# EasyEDA Pro project MAX2831_Standalone.eprj

# Schematic Schematic1
Create Date: 2024-09-24; Page Name: P1; Project Name: MAX2831_Standalone; Schematic Name: Schematic1; Update Date: 2024-10-01; Company: EasyEDA.com; Drawn: EasyEDA; Page Size: A4; Part Number: JLCPCB-002; Reviewed: EasyEDA; Version: V0.1
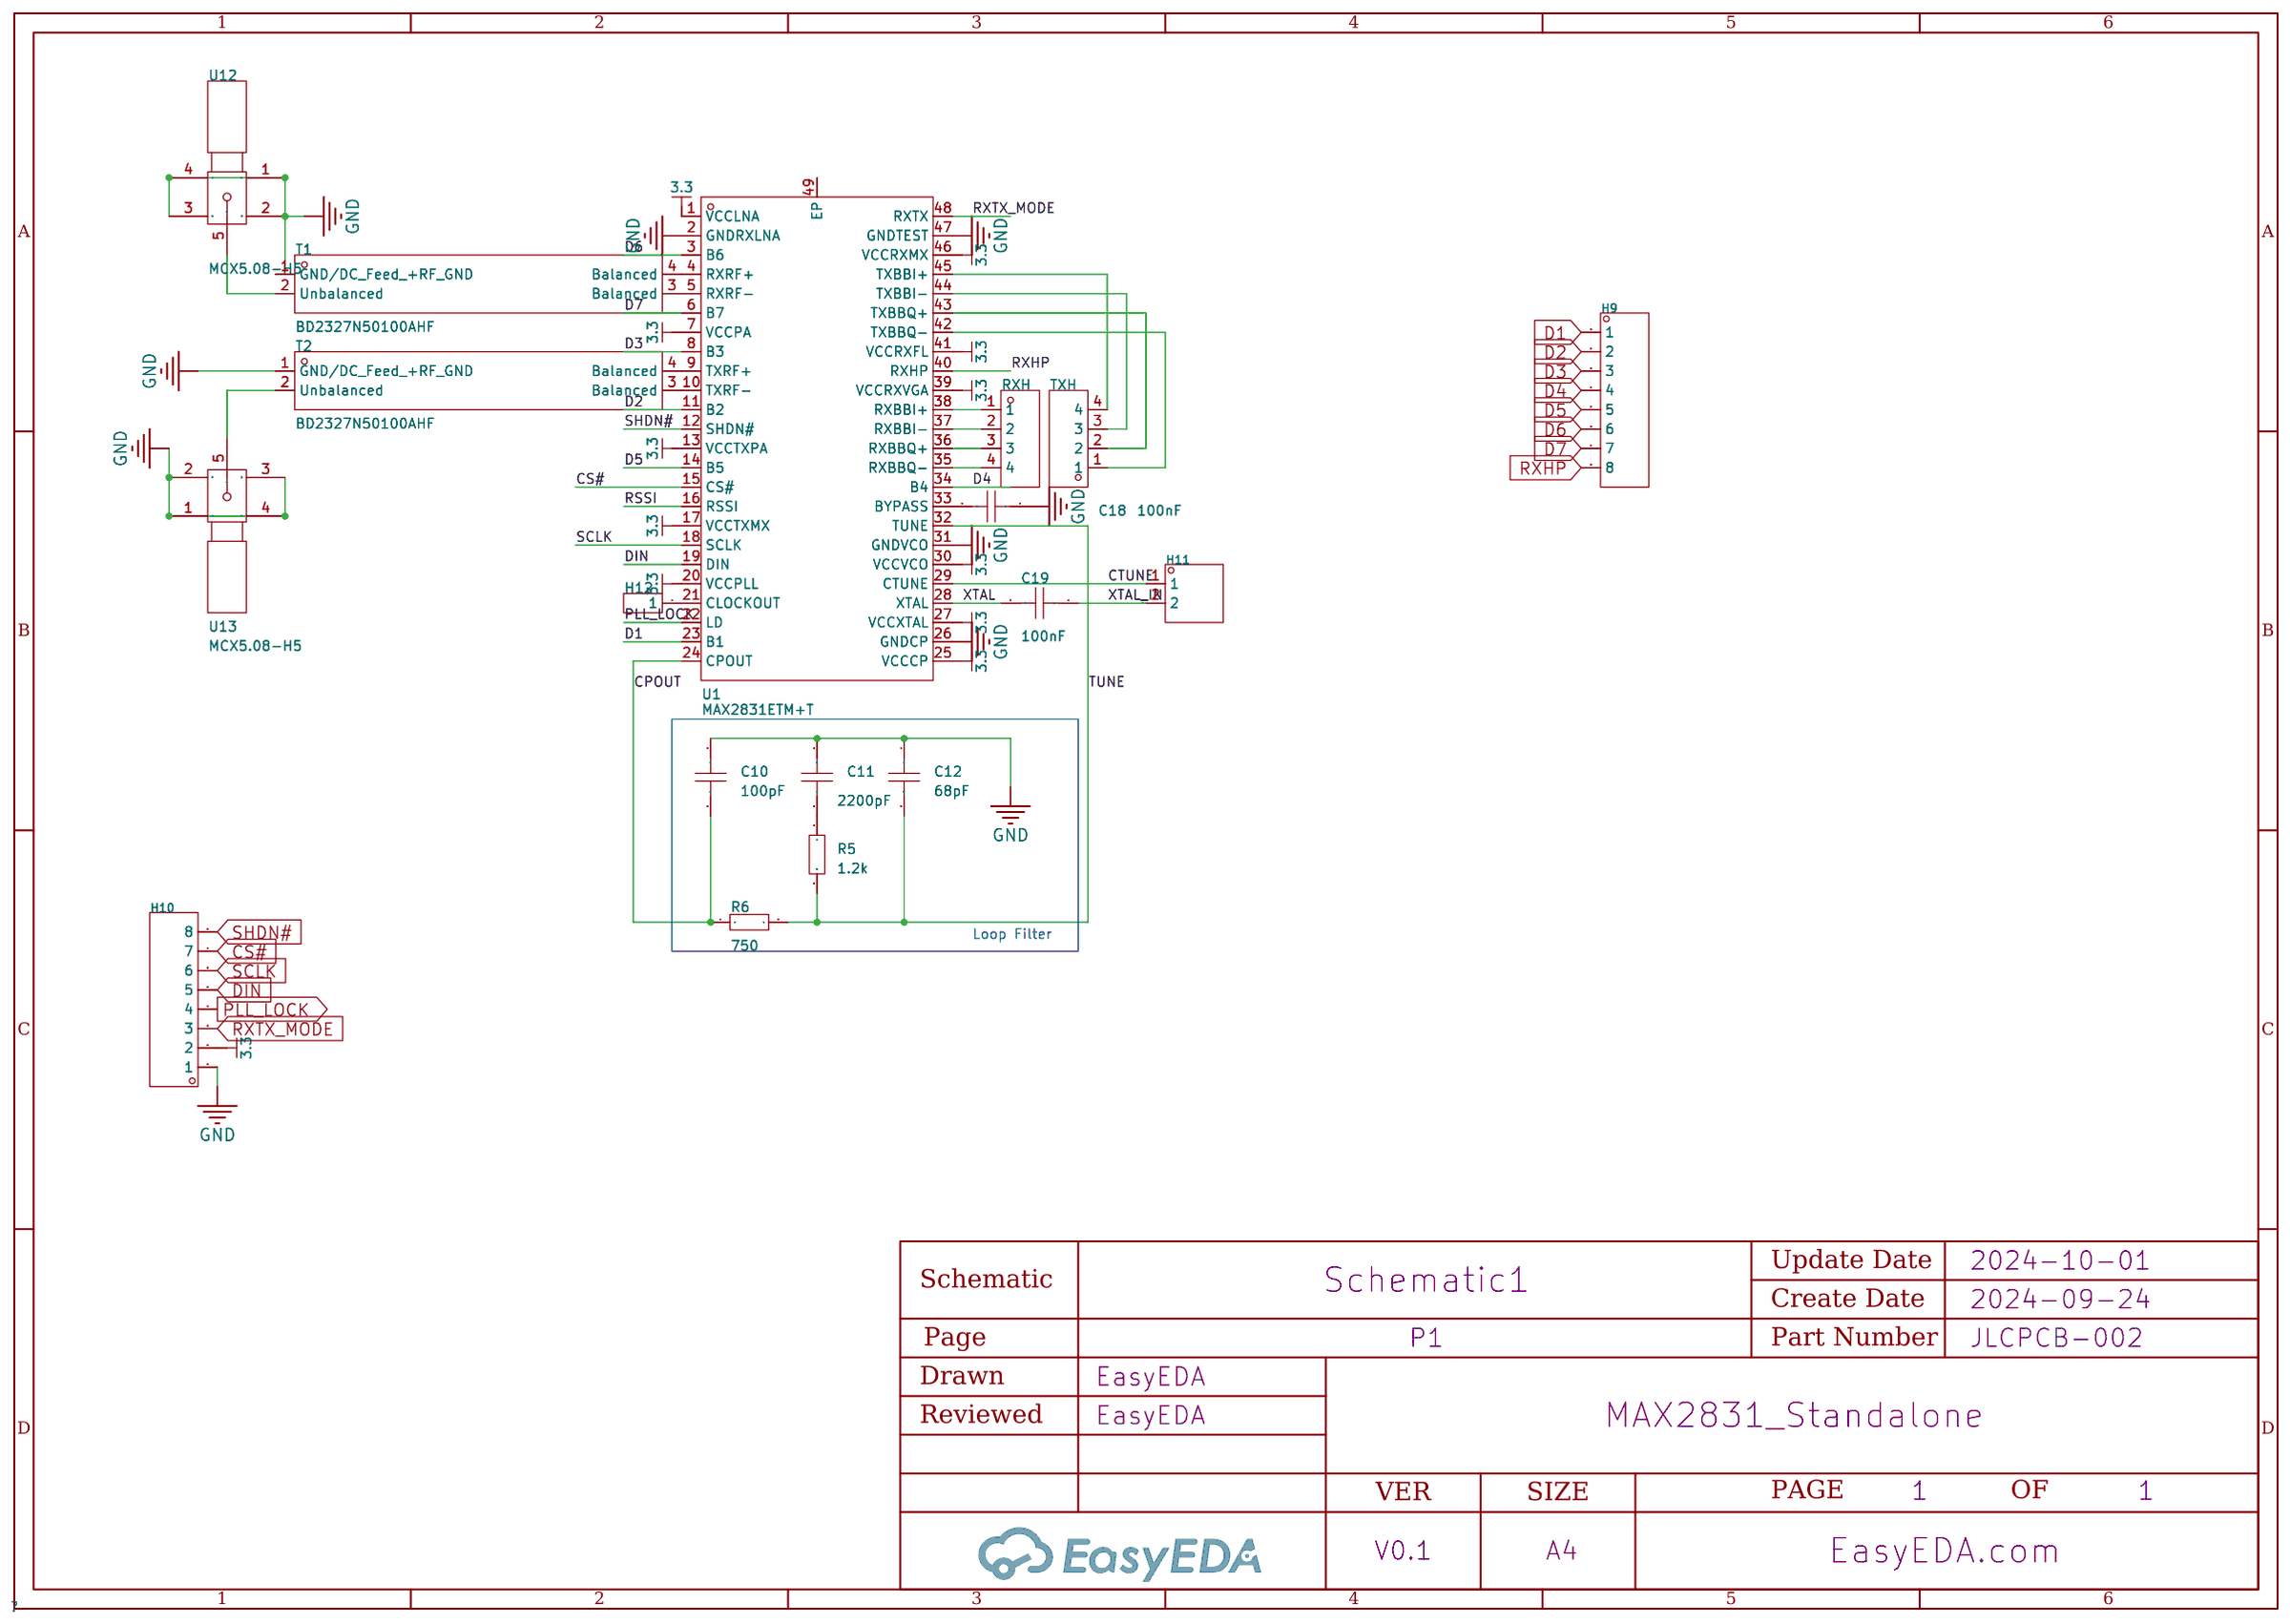
[diagram p0: schematic sheet]

## Parts
C10  100pF  [C0402]
C11  2200pF  [C0402]
C12  68pF  [C0402]
C18  100nF  [C0603]
C19  100nF  [C0603]
H9  -  [HDR-TH_8P-P2.54-V-M]
H10  -  [HDR-TH_8P-P2.54-V-M]
H11  -  [HDR-TH_2P-P2.54-V-M-1]
H12  -  [HDR-TH_1P-V-M_XKB_X4611WV-01I-C28D40]
R5  1.2k  [R0603]
R6  750  [R0603]
RXH  -  [HDR-TH_4P-P2.54-V-M]
T1  BD2327N50100AHF  [XFMR-SMD_4P-L1.1-W1.1-P0.50-BL]
T2  BD2327N50100AHF  [XFMR-SMD_4P-L1.1-W1.1-P0.50-BL]
TXH  -  [HDR-TH_4P-P2.54-V-M]
U1  MAX2831ETM+T  [TQFN-48_L7.0-W7.0-P0.50-TL-EP5.6]
U12  MCX5.08-H5  [SMA-TH_MCX5.08-H5]
U13  MCX5.08-H5  [SMA-TH_MCX5.08-H5]

## Library data of the parts
C10-C12 = CAP_0402: Supplier Part: C1525; Supplier Footprint: 0402
C18 C19 = CAP_0603: Supplier Footprint: 0603
H9 H10 = HDR-M_2.54_1x8P: Supplier Footprint: Through
H11 = HDR-M_2.54_1x2P: Supplier Footprint: Through
H12 = HDR-M_2.54_1x1P: Supplier Footprint: Through
R5 R6 = Res_0603: Supplier Footprint: 0603
RXH TXH = HDR-M_2.54_1x4P: Supplier Footprint: Through
T1 T2 = BD2327N50100AHF: Frequency Range:2.3GHz~2.7GHz Frequency Range:2.3GHz~2.7GHz Impedance Ratio-Unbalanced/Balanced:50Ω:100Ω Insertion Loss (Max):0.6dB Phase Balance:7° Return Loss (Min):-17dB; Supplier Part: C502744; Manufacturer: Anaren(安伦); Supplier Footprint: 0404; JLCPCB Part Class: Extended Part; Datasheet: https://atta.szlcsc.com/upload/public/pdf/source/20200325/C502744_600AEA0B929E69ACF1DE72B8D5B44231.pdf; Supplier: LCSC; Frequency Range: 2.3GHz~2.7GHz; Impedance Ratio-Unbalanced/Balanced: 50Ω:100Ω; Insertion Loss (Max): 0.6dB; Phase Balance: 7°; Return Loss (Min): -17dB
U1 = MAX2831ETM+T: Frequency Range:2.4GHz Frequency Range:2.4GHz Interface:SPI Operating Voltage:2.7V~3.6V Operating Voltage:2.7V~3.6V Applications:WiFi Output Power:21dBm Data Rate:54Mbps Current Of Transmitting:82mA Sensitivity:-76dBm Receive Current:62mA Operating Temper; Supplier Part: C2152047; Manufacturer: ADI(亚德诺)/MAXIM(美信); Supplier Footprint: TQFN-48-EP(7x7); JLCPCB Part Class: Extended Part; Datasheet: https://atta.szlcsc.com/upload/public/pdf/source/20210601/D5E13A4F591163B65DE03F91E5182685.pdf; Supplier: LCSC; Frequency Range: 2.4GHz; Interface: SPI; Operating Voltage: 2.7V~3.6V; Applications: WiFi; Output Power: 21dBm; Data Rate: 54Mbps; Current Of Transmitting: 82mA; Sensitivity: -76dBm; Receive Current: 62mA; Operating Temperature: -40℃~+85℃
U12 U13 = MCX5.08-H5_C9900009324: Supplier Part: C9900009324; Supplier Footprint: COAX-F; JLCPCB Part Class: Extended Part; Supplier: LCSC

## Nets
GND: C10.1 C11.1 C12.1 C18.1 H10.1 T1.1(GND/DC Feed +RF GND) T2.1(GND/DC Feed +RF GND) U1.2(GNDRXLNA) U1.26(GNDCP) U1.31(GNDVCO) U1.47(GNDTEST) U12.1 U12.2 U12.3 U12.4 U13.1 U13.2 U13.3 U13.4
3.3: H10.2 U1.1(VCCLNA) U1.7(VCCPA) U1.13(VCCTXPA) U1.17(VCCTXMX) U1.20(VCCPLL) U1.25(VCCCP) U1.27(VCCXTAL) U1.30(VCCVCO) U1.39(VCCRXVGA) U1.41(VCCRXFL) U1.46(VCCRXMX)
CPOUT: C10.2 R6.1 U1.24(CPOUT)
CS#: H10.7 U1.15(CS#)
CTUNE: H11.1 U1.29(CTUNE)
D1: H9.1 U1.23(B1)
D2: H9.2 U1.11(B2)
D3: H9.3 U1.8(B3)
D4: H9.4 U1.34(B4)
D5: H9.5 U1.14(B5)
D6: H9.6 U1.3(B6)
D7: H9.7 U1.6(B7)
DIN: H10.5 U1.19(DIN)
PLL_LOCK: H10.4 U1.22(LD)
RSSI: U1.16(RSSI)
RXHP: H9.8 U1.40(RXHP)
RXTX_MODE: H10.3 U1.48(RXTX)
SCLK: H10.6 U1.18(SCLK)
SHDN#: H10.8 U1.12(SHDN#)
TUNE: C12.2 R5.2 R6.2 U1.32(TUNE)
XTAL: C19.2 U1.28(XTAL)
XTAL_IN: C19.1 H11.2
$1N1573: C11.2 R5.1
$1N2083: C18.2 U1.33(BYPASS)
$1N2220: T1.4(Balanced) U1.4(RXRF+)
$1N2222: T1.3(Balanced) U1.5(RXRF-)
$1N2224: T2.4(Balanced) U1.9(TXRF+)
$1N2226: T2.3(Balanced) U1.10(TXRF-)
$1N4327: TXH.4 U1.45(TXBBI+)
$1N4335: TXH.3 U1.44(TXBBI-)
$1N4341: TXH.2 U1.43(TXBBQ+)
$1N4346: TXH.1 U1.42(TXBBQ-)
$1N4508: T2.2(Unbalanced) U13.5
$1N4512: T1.2(Unbalanced) U12.5
$1N6688: RXH.1 U1.38(RXBBI+)
$1N6690: RXH.2 U1.37(RXBBI-)
$1N6692: RXH.3 U1.36(RXBBQ+)
$1N6694: RXH.4 U1.35(RXBBQ-)
$1N7209: H12.1 U1.21(CLOCKOUT)

Not connected (* = marked no-connect by the designer): U1 49(EP)

## Notes on the sheet
- Loop Filter

# Schematic Schematic2
Create Date: 2024-09-25; Page Name: P1; Project Name: MAX2831_Standalone; Schematic Name: Schematic2; Update Date: 2024-09-25; Company: EasyEDA.com; Drawn: EasyEDA; Page Size: A4; Part Number: JLCPCB-002; Reviewed: EasyEDA; Version: V0.1
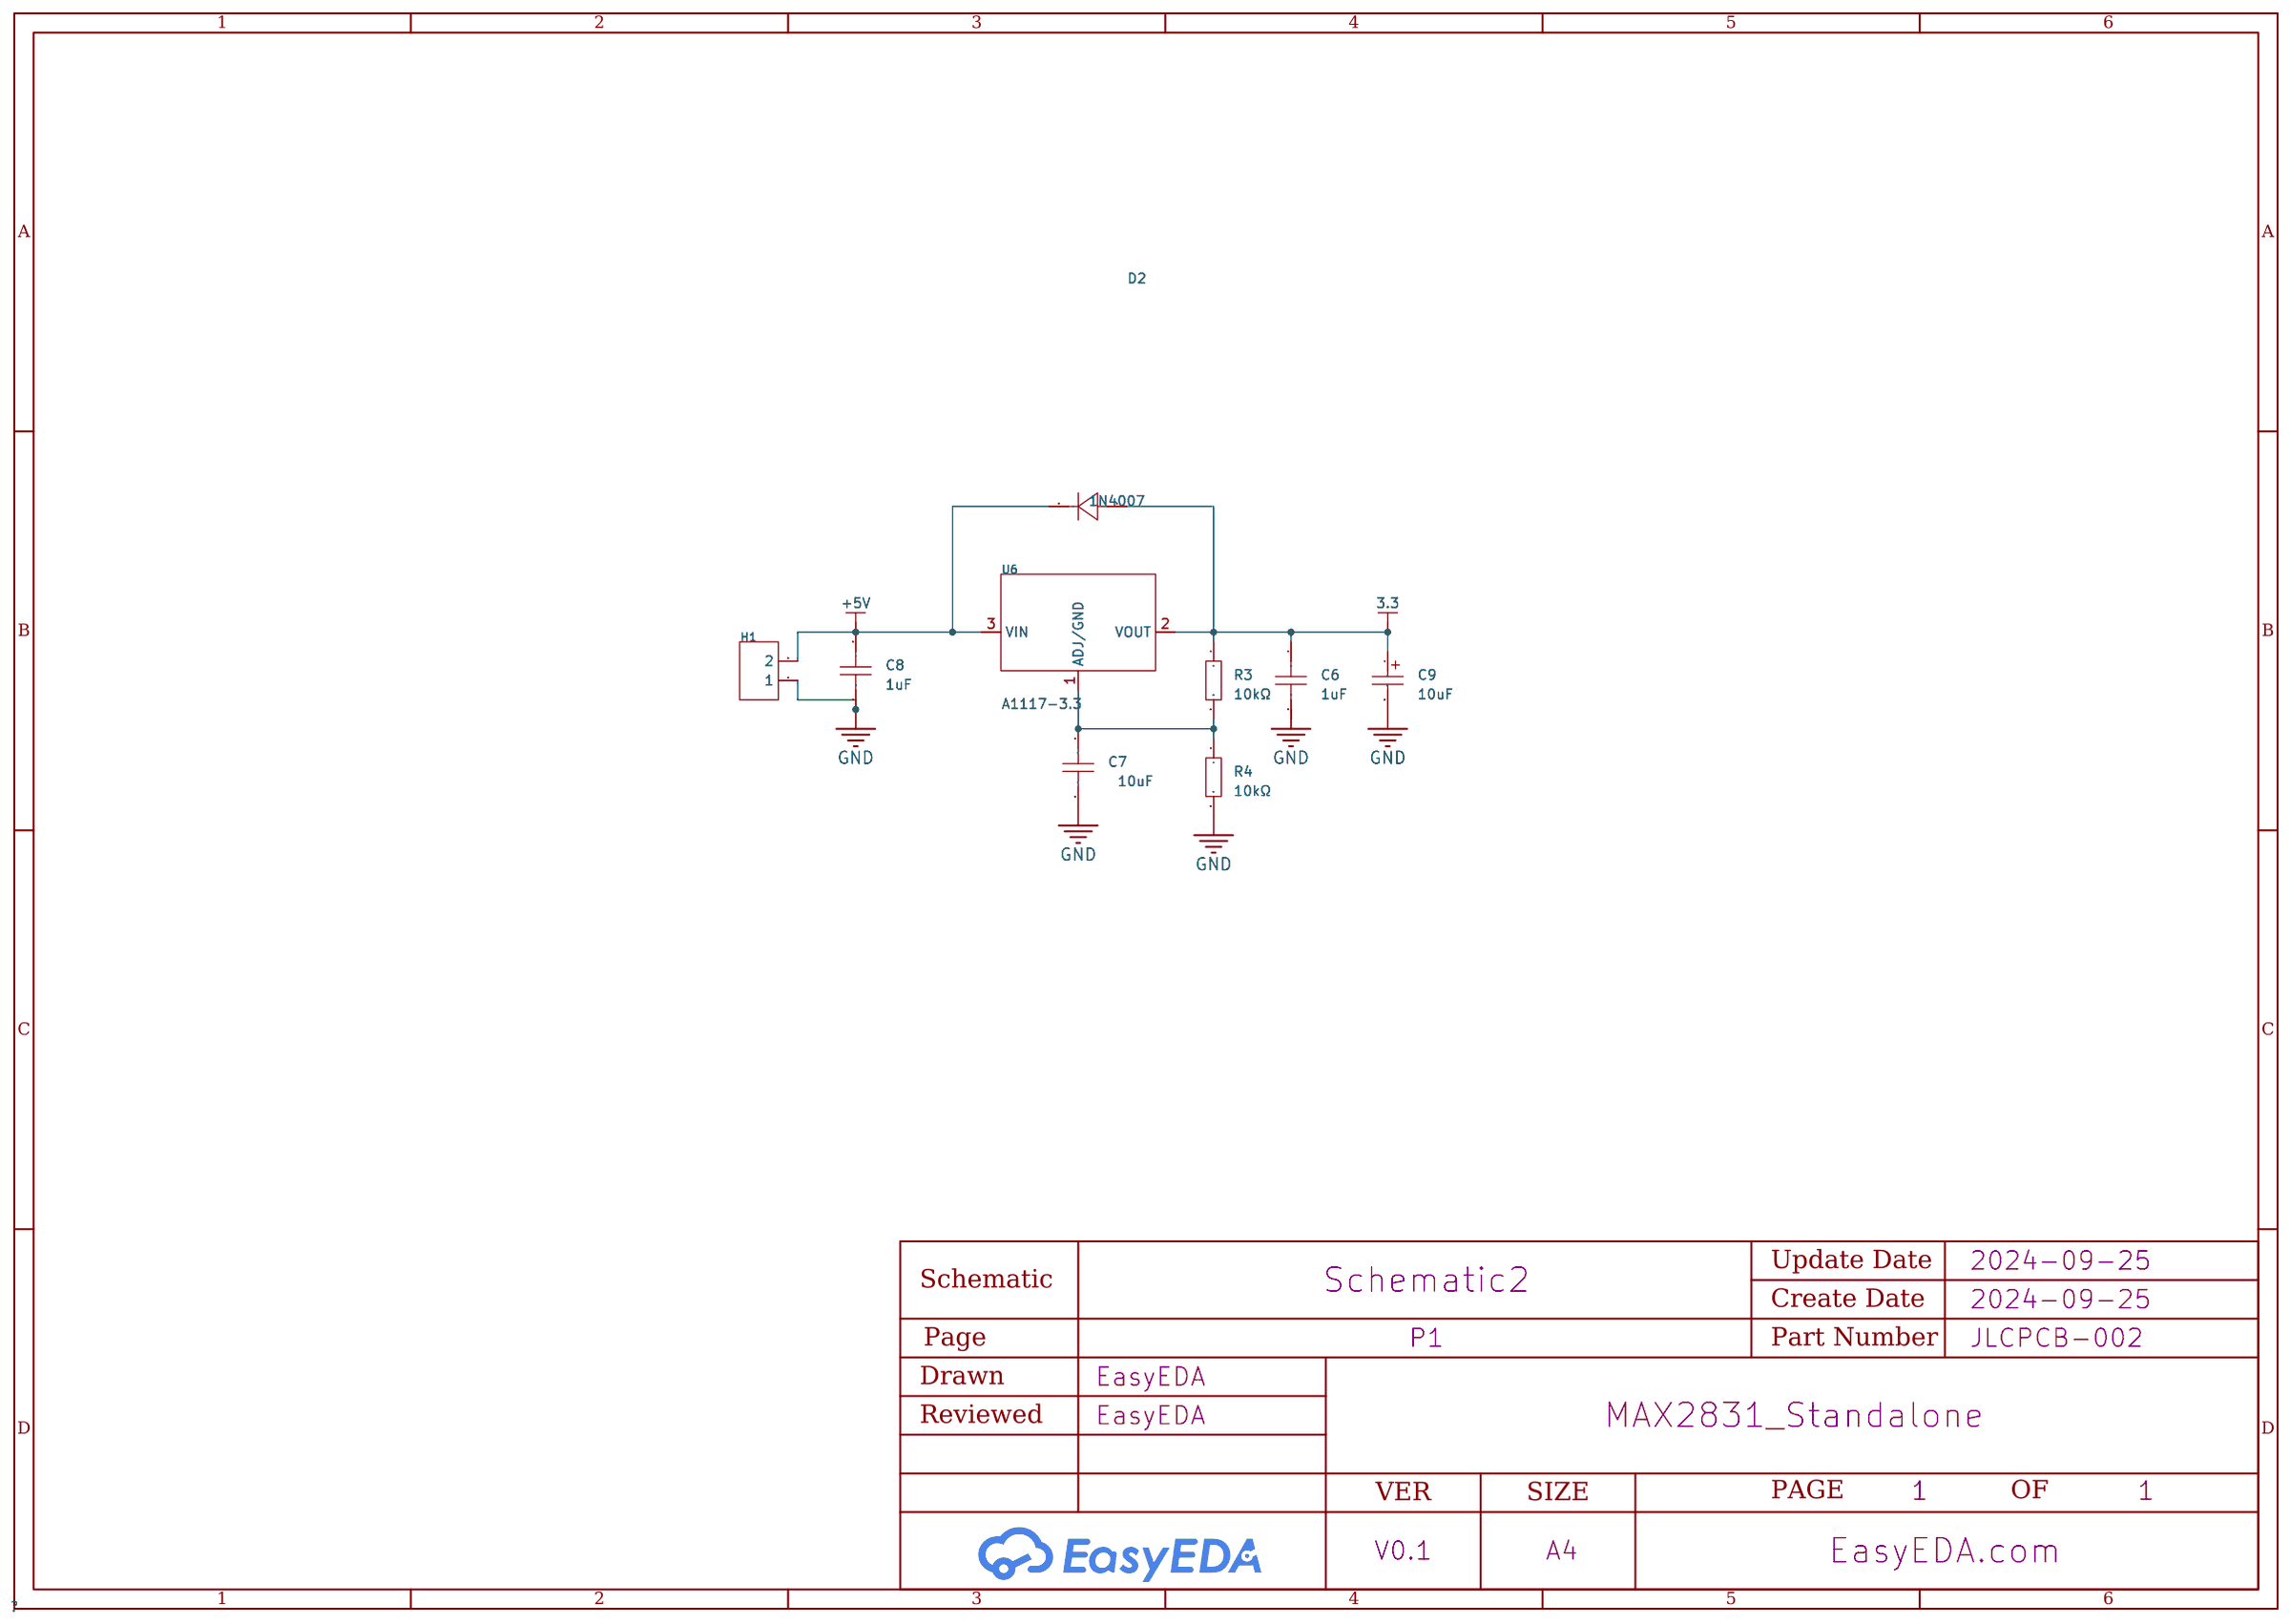
[diagram p1: schematic sheet]

## Parts
C6  1uF  [C0603]
C7  10uF  [C0603]
C8  1uF  [C0603]
C9  10uF  [CAP-SMD_BD3.0-L3.3-W3.3-RD]
D2  1N4007  [SMAF_L3.5-W2.6-LS4.7-RD]
H1  -  [HDR-TH_2P-P2.54-V-F]
R3  10kΩ  [RES-TH_BD3.3-L9.0-P13.00-D0.6]
R4  10kΩ  [RES-TH_BD3.3-L9.0-P13.00-D0.6]
U6  A1117-3.3  [SOT-223-3_L6.5-W3.4-P2.30-LS7.0-BR-1]

## Library data of the parts
C6-C8 = CAP_0603: Supplier Footprint: 0603
C9 = C_Ele_SMD_3x5.4mm: Supplier Footprint: SMD,3x5.4mm
D2 = 1N4007_C2909975: Diode Configuration:Independent Type Forward Voltage (Vf@If):1.1V@1A Reverse Voltage (Vr): Rectified Current: Reverse Leakage Current:5uA@1kV; LCSC Part Name: 电压:1kV 电流:1A; Supplier Part: C2909975; Manufacturer: YONGYUTAI(永裕泰); Supplier Footprint: SMAF; JLCPCB Part Class: Extended Part; Datasheet: https://atta.szlcsc.com/upload/public/pdf/source/20211027/84ABD1D59134F7D0F7A37088EC700D05.pdf; Supplier: LCSC; Diode Configuration: Independent Type; Forward Voltage (Vf@If): 1.1V@1A; Reverse Leakage Current: 5uA@1kV
H1 = HDR-F_2.54_1x2P: Supplier Footprint: Through
R3 R4 = Res_AXIAL-1/2W: Supplier Footprint: Through
U6 = A1117-3.3: MAX Output Current:1A Feature:Overcurrent Protection；过热保护; LCSC Part Name: AMS1117-3.3; Supplier Part: C7432020; Manufacturer: IDCHIP(英锐芯); Supplier Footprint: SOT-223; JLCPCB Part Class: Extended Part; Datasheet: https://atta.szlcsc.com/upload/public/pdf/source/20230625/435FEEFA02C0FE449E7397A11F8448E0.pdf; Supplier: LCSC; MAX Output Current: 1A; Feature: Overcurrent Protection；过热保护

## Nets
+5V: C8.1 D2.1(K) H1.2 U6.3(VIN)
GND: C6.2 C7.2 C8.2 C9.2 H1.1 R4.2
3.3: C6.1 C9.1 D2.2(A) R3.1 U6.2(VOUT)
Net-(C7-1): C7.1 R3.2 R4.1 U6.1(ADJ/GND)

# Schematic Schematic3
Create Date: 2024-10-04; Page Name: P1; Project Name: MAX2831_Standalone; Schematic Name: Schematic3; Update Date: 2024-11-10; Company: EasyEDA.com; Drawn: EasyEDA; Page Size: A4; Part Number: JLCPCB-002; Reviewed: EasyEDA; Version: V0.1